# EasyEDA Pro project wukong01-Y003-HTOL.eprj, board PCB1 (continued)
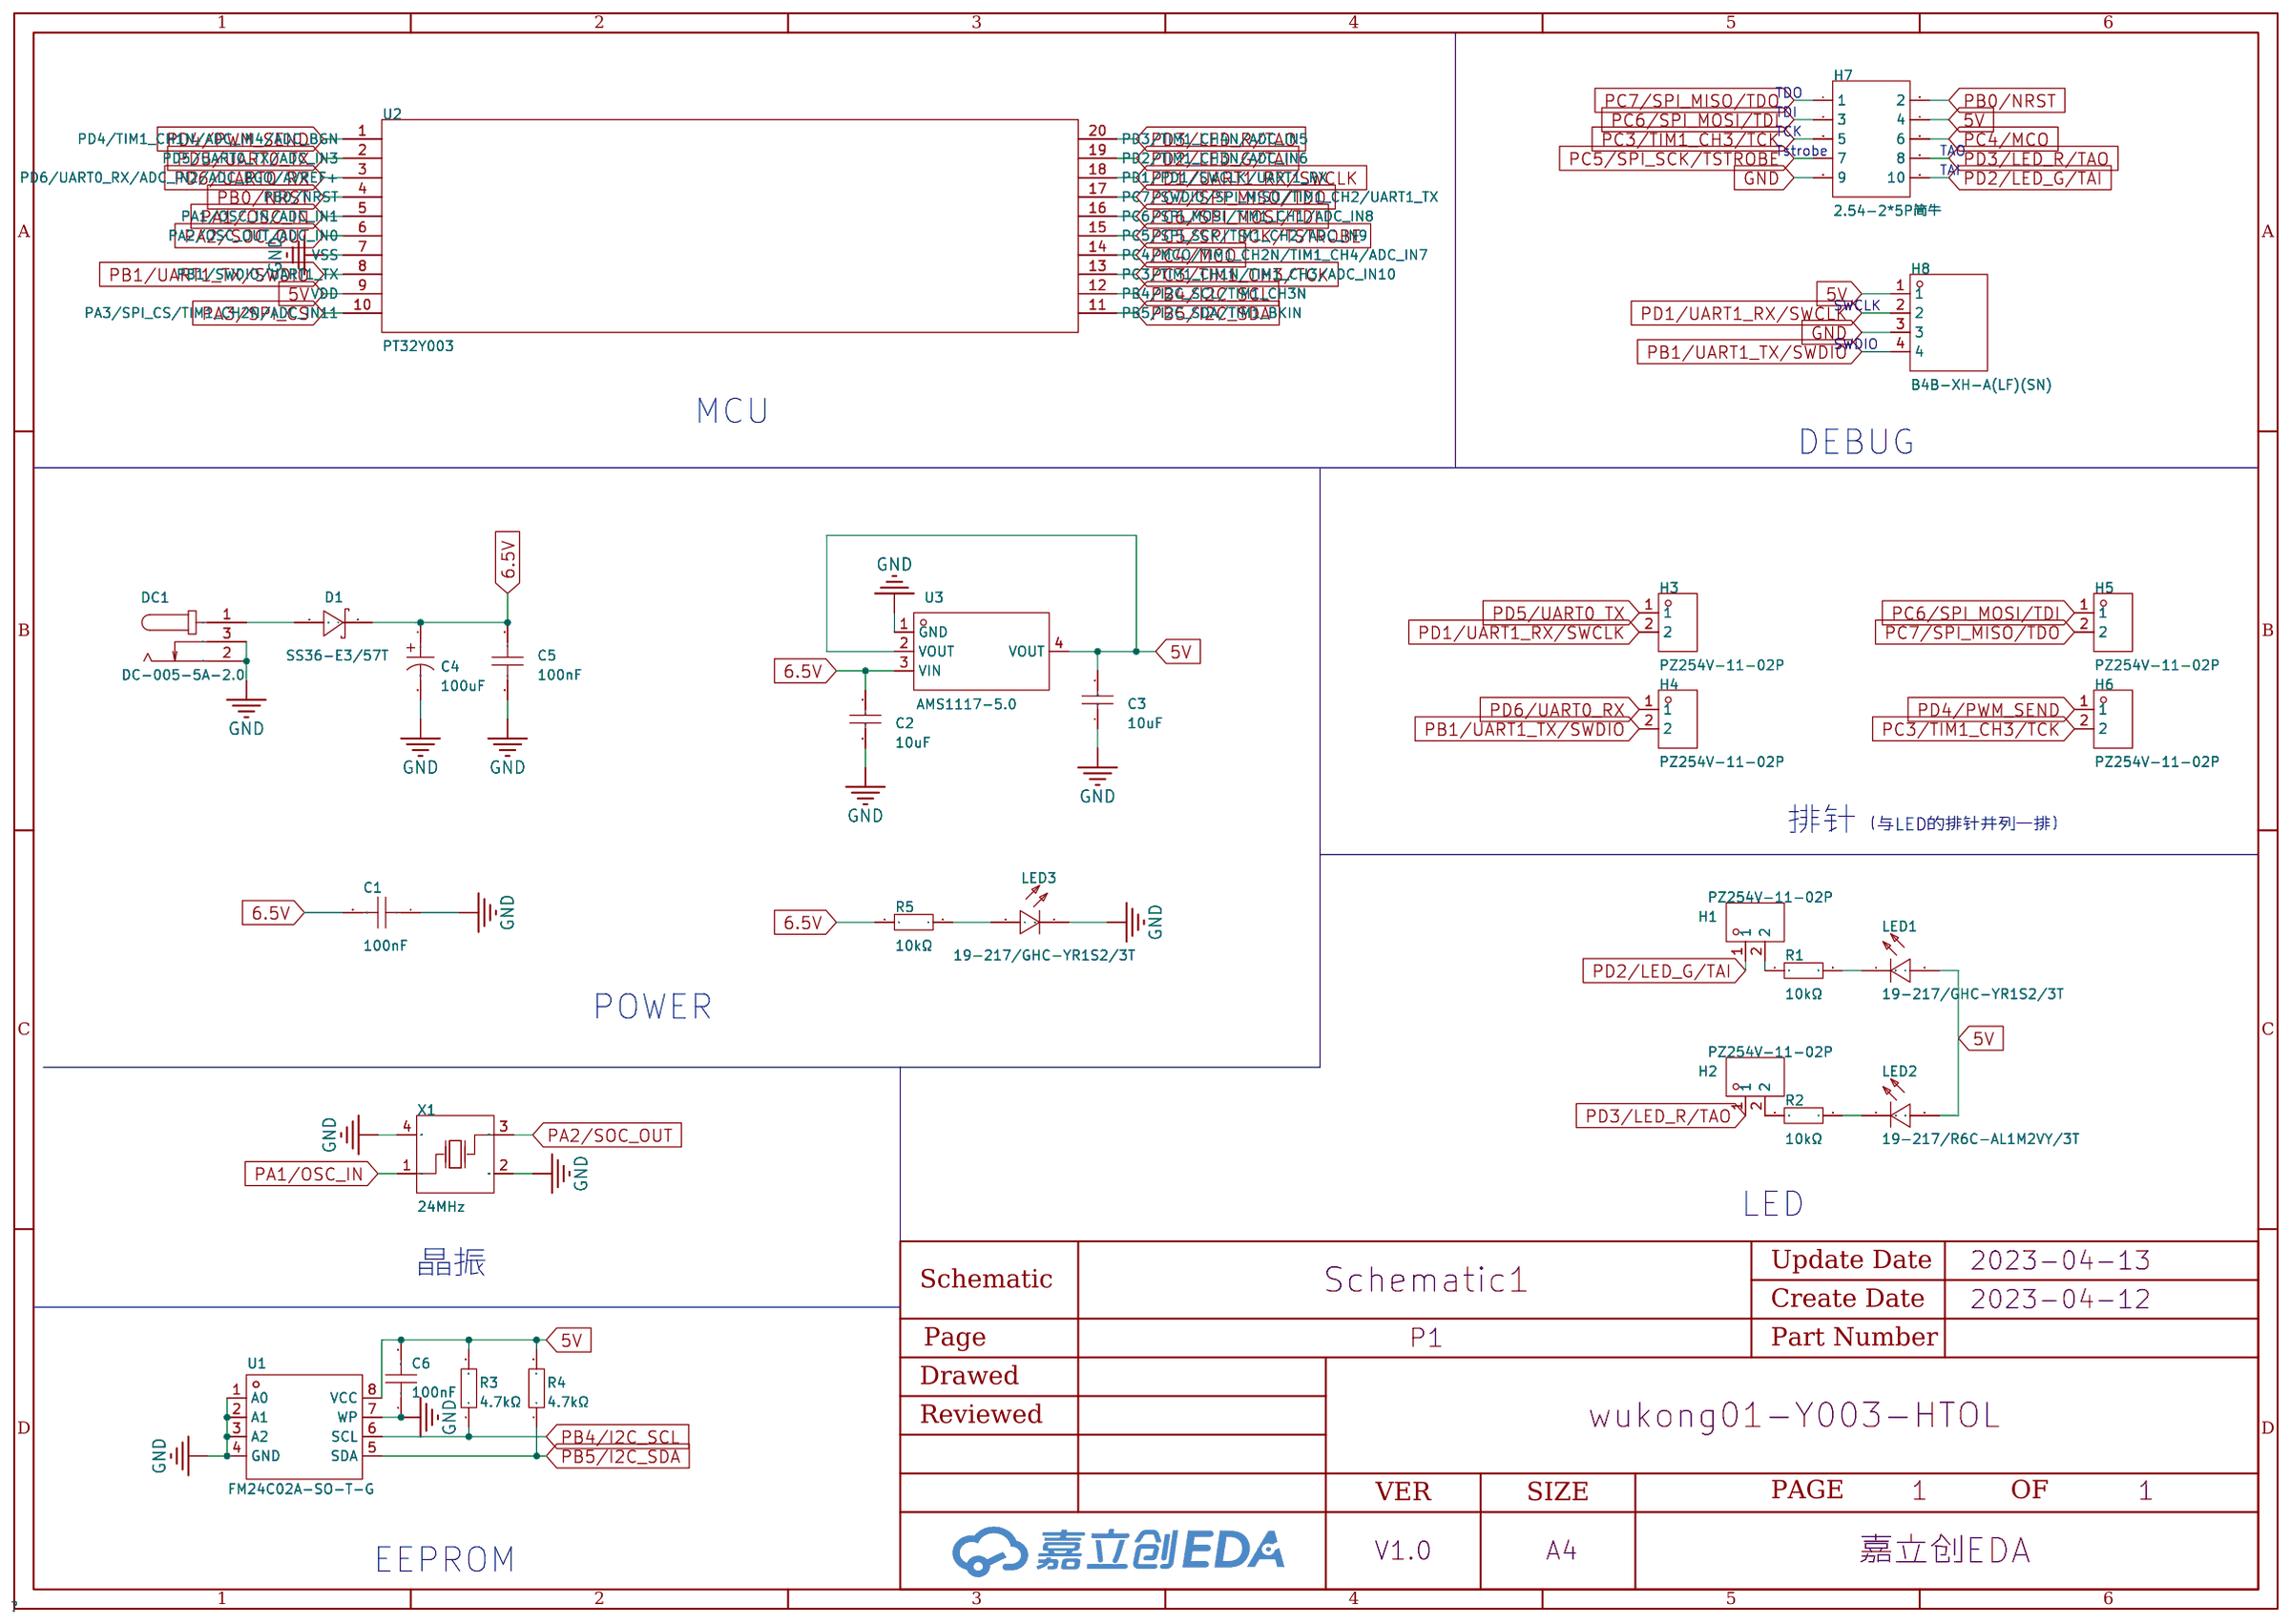
[diagram p0: schematic sheet]
## Placement (name value [footprint] x y rotation side) (continued)
H8#19  -  [CONN-TH_B4B-XH-A-LF-SN]  176.15 37.85 0 top
H8#20  -  [CONN-TH_B4B-XH-A-LF-SN]  127.13 37.85 0 top
H8#21  -  [CONN-TH_B4B-XH-A-LF-SN]  225.17 37.85 0 top
H8#22  -  [CONN-TH_B4B-XH-A-LF-SN]  225.17 80.77 0 top
H8#23  -  [CONN-TH_B4B-XH-A-LF-SN]  78.11 252.48 0 top
H8#24  -  [CONN-TH_B4B-XH-A-LF-SN]  176.15 252.48 0 top
H8#25  -  [CONN-TH_B4B-XH-A-LF-SN]  127.13 252.48 0 top
H8#26  -  [CONN-TH_B4B-XH-A-LF-SN]  274.19 252.48 0 top
H8#27  -  [CONN-TH_B4B-XH-A-LF-SN]  225.17 252.48 0 top
H8#28  -  [CONN-TH_B4B-XH-A-LF-SN]  29.08 252.48 0 top
H8#29  -  [CONN-TH_B4B-XH-A-LF-SN]  78.11 209.55 0 top
H8#30  -  [CONN-TH_B4B-XH-A-LF-SN]  176.15 209.55 0 top
H8#31  -  [CONN-TH_B4B-XH-A-LF-SN]  127.13 209.55 0 top
H8#32  -  [CONN-TH_B4B-XH-A-LF-SN]  274.19 209.55 0 top
H8#33  -  [CONN-TH_B4B-XH-A-LF-SN]  225.17 209.55 0 top
H8#34  -  [CONN-TH_B4B-XH-A-LF-SN]  29.08 209.55 0 top
H8#35  -  [CONN-TH_B4B-XH-A-LF-SN]  78.11 166.62 0 top
H8#36  -  [CONN-TH_B4B-XH-A-LF-SN]  176.15 166.62 0 top
H8#37  -  [CONN-TH_B4B-XH-A-LF-SN]  127.13 166.62 0 top
H8#38  -  [CONN-TH_B4B-XH-A-LF-SN]  274.19 166.62 0 top
H8#39  -  [CONN-TH_B4B-XH-A-LF-SN]  225.17 166.62 0 top
H8#40  -  [CONN-TH_B4B-XH-A-LF-SN]  29.08 166.62 0 top
LED1  19-217/GHC-YR1S2/3T  [LED0603-RD]  127.82 93.15 180 top
LED1#2  -  [LED0603-RD]  225.87 93.15 180 top
LED1#3  -  [LED0603-RD]  29.78 93.15 180 top
LED1#4  -  [LED0603-RD]  274.89 93.15 180 top
LED1#5  -  [LED0603-RD]  176.84 93.15 180 top
LED1#6  -  [LED0603-RD]  78.8 93.15 180 top
LED1#7  -  [LED0603-RD]  78.8 264.86 180 top
LED1#8  -  [LED0603-RD]  127.82 264.86 180 top
LED1#9  -  [LED0603-RD]  176.84 264.86 180 top
LED1#10  -  [LED0603-RD]  225.87 50.23 180 top
LED1#11  -  [LED0603-RD]  225.87 264.86 180 top
LED1#12  -  [LED0603-RD]  29.78 7.3 180 top
LED1#13  -  [LED0603-RD]  274.89 264.86 180 top
LED1#14  -  [LED0603-RD]  176.84 50.23 180 top
LED1#15  -  [LED0603-RD]  225.87 7.3 180 top
LED1#16  -  [LED0603-RD]  176.84 7.3 180 top
LED1#17  -  [LED0603-RD]  274.89 50.23 180 top
LED1#18  -  [LED0603-RD]  29.78 50.23 180 top
LED1#19  -  [LED0603-RD]  127.82 50.23 180 top
LED1#20  -  [LED0603-RD]  127.82 7.3 180 top
LED1#21  -  [LED0603-RD]  78.8 7.3 180 top
LED1#22  -  [LED0603-RD]  78.8 50.23 180 top
LED1#23  -  [LED0603-RD]  127.82 221.93 180 top
LED1#24  -  [LED0603-RD]  225.87 221.93 180 top
LED1#25  -  [LED0603-RD]  29.78 221.93 180 top
LED1#26  -  [LED0603-RD]  274.89 221.93 180 top
LED1#27  -  [LED0603-RD]  176.84 221.93 180 top
LED1#28  -  [LED0603-RD]  78.8 221.93 180 top
LED1#29  -  [LED0603-RD]  127.82 179 180 top
LED1#30  -  [LED0603-RD]  225.87 179 180 top
LED1#31  -  [LED0603-RD]  29.78 179 180 top
LED1#32  -  [LED0603-RD]  274.89 179 180 top
LED1#33  -  [LED0603-RD]  176.84 179 180 top
LED1#34  -  [LED0603-RD]  78.8 179 180 top
LED1#35  -  [LED0603-RD]  127.82 136.08 180 top
LED1#36  -  [LED0603-RD]  225.87 136.08 180 top
LED1#37  -  [LED0603-RD]  29.78 136.08 180 top
LED1#38  -  [LED0603-RD]  274.89 136.08 180 top
LED1#39  -  [LED0603-RD]  176.84 136.08 180 top
LED1#40  -  [LED0603-RD]  78.8 136.08 180 top
LED2  19-217/R6C-AL1M2VY/3T  [LED0603-R-RD]  29.84 137.8 180 top
LED2#2  -  [LED0603-R-RD]  127.89 137.8 180 top
LED2#3  -  [LED0603-R-RD]  176.91 137.8 180 top
LED2#4  -  [LED0603-R-RD]  274.96 137.8 180 top
LED2#5  -  [LED0603-R-RD]  225.93 94.87 180 top
LED2#6  -  [LED0603-R-RD]  78.87 94.87 180 top
LED2#7  -  [LED0603-R-RD]  29.84 94.87 180 top
LED2#8  -  [LED0603-R-RD]  127.89 94.87 180 top
LED2#9  -  [LED0603-R-RD]  176.91 94.87 180 top
LED2#10  -  [LED0603-R-RD]  274.96 94.87 180 top
LED2#11  -  [LED0603-R-RD]  78.87 266.57 180 top
LED2#12  -  [LED0603-R-RD]  176.91 266.57 180 top
LED2#13  -  [LED0603-R-RD]  127.89 266.57 180 top
LED2#14  -  [LED0603-R-RD]  274.96 266.57 180 top
LED2#15  -  [LED0603-R-RD]  225.93 266.57 180 top
LED2#16  -  [LED0603-R-RD]  29.84 9.02 180 top
LED2#17  -  [LED0603-R-RD]  78.87 51.94 180 top
LED2#18  -  [LED0603-R-RD]  176.91 9.02 180 top
LED2#19  -  [LED0603-R-RD]  127.89 9.02 180 top
LED2#20  -  [LED0603-R-RD]  225.93 51.94 180 top
LED2#21  -  [LED0603-R-RD]  78.87 9.02 180 top
LED2#22  -  [LED0603-R-RD]  127.89 51.94 180 top
LED2#23  -  [LED0603-R-RD]  176.91 51.94 180 top
LED2#24  -  [LED0603-R-RD]  225.93 9.02 180 top
LED2#25  -  [LED0603-R-RD]  274.96 51.94 180 top
LED2#26  -  [LED0603-R-RD]  29.84 51.94 180 top
LED2#27  -  [LED0603-R-RD]  225.93 223.65 180 top
LED2#28  -  [LED0603-R-RD]  78.87 223.65 180 top
LED2#29  -  [LED0603-R-RD]  29.84 223.65 180 top
LED2#30  -  [LED0603-R-RD]  127.89 223.65 180 top
LED2#31  -  [LED0603-R-RD]  176.91 223.65 180 top
LED2#32  -  [LED0603-R-RD]  274.96 223.65 180 top
LED2#33  -  [LED0603-R-RD]  225.93 180.72 180 top
LED2#34  -  [LED0603-R-RD]  78.87 180.72 180 top
LED2#35  -  [LED0603-R-RD]  29.84 180.72 180 top
LED2#36  -  [LED0603-R-RD]  127.89 180.72 180 top
LED2#37  -  [LED0603-R-RD]  176.91 180.72 180 top
LED2#38  -  [LED0603-R-RD]  274.96 180.72 180 top
LED2#39  -  [LED0603-R-RD]  225.93 137.8 180 top
LED2#40  -  [LED0603-R-RD]  78.87 137.8 180 top
LED3  19-217/GHC-YR1S2/3T  [LED0603-RD]  28.19 284.23 90 top
R1  10kΩ  [R0603]  230.5 93.09 180 top
R1#2  -  [R0603]  181.48 93.09 180 top
R1#3  -  [R0603]  279.53 93.09 180 top
R1#4  -  [R0603]  83.44 93.09 180 top
R1#5  -  [R0603]  34.42 93.09 180 top
R1#6  -  [R0603]  132.46 93.09 180 top
R1#7  -  [R0603]  83.44 264.8 180 top
R1#8  -  [R0603]  181.48 264.8 180 top
R1#9  -  [R0603]  132.46 264.8 180 top
R1#10  -  [R0603]  230.5 50.17 180 top
R1#11  -  [R0603]  279.53 264.8 180 top
R1#12  -  [R0603]  181.48 50.17 180 top
R1#13  -  [R0603]  230.5 264.8 180 top
R1#14  -  [R0603]  230.5 178.94 180 top
R1#15  -  [R0603]  181.48 7.24 180 top
R1#16  -  [R0603]  279.53 50.17 180 top
R1#17  -  [R0603]  83.44 50.17 180 top
R1#18  -  [R0603]  132.46 50.17 180 top
R1#19  -  [R0603]  230.5 7.24 180 top
R1#20  -  [R0603]  132.46 7.24 180 top
R1#21  -  [R0603]  34.42 50.17 180 top
R1#22  -  [R0603]  34.42 7.24 180 top
R1#23  -  [R0603]  83.44 7.24 180 top
R1#24  -  [R0603]  230.5 221.87 180 top
R1#25  -  [R0603]  181.48 221.87 180 top
R1#26  -  [R0603]  279.53 221.87 180 top
R1#27  -  [R0603]  83.44 221.87 180 top
R1#28  -  [R0603]  34.42 221.87 180 top
R1#29  -  [R0603]  132.46 221.87 180 top
R1#30  -  [R0603]  181.48 178.94 180 top
R1#31  -  [R0603]  279.53 178.94 180 top
R1#32  -  [R0603]  83.44 178.94 180 top
R1#33  -  [R0603]  34.42 178.94 180 top
R1#34  -  [R0603]  132.46 178.94 180 top
R1#35  -  [R0603]  230.5 136.02 180 top
R1#36  -  [R0603]  181.48 136.02 180 top
R1#37  -  [R0603]  279.53 136.02 180 top
R1#38  -  [R0603]  83.44 136.02 180 top
R1#39  -  [R0603]  34.42 136.02 180 top
R1#40  -  [R0603]  132.46 136.02 180 top
R2  10kΩ  [R0603]  230.49 94.74 180 top
R2#2  -  [R0603]  181.46 94.74 180 top
R2#3  -  [R0603]  279.51 94.74 180 top
R2#4  -  [R0603]  34.4 94.74 180 top
R2#5  -  [R0603]  132.44 94.74 180 top
R2#6  -  [R0603]  83.42 94.74 180 top
R2#7  -  [R0603]  83.42 266.44 180 top
R2#8  -  [R0603]  132.44 266.44 180 top
R2#9  -  [R0603]  181.46 266.44 180 top
R2#10  -  [R0603]  230.49 51.81 180 top
R2#11  -  [R0603]  230.49 266.44 180 top
R2#12  -  [R0603]  279.51 266.44 180 top
R2#13  -  [R0603]  181.46 51.81 180 top
R2#14  -  [R0603]  181.46 8.89 180 top
R2#15  -  [R0603]  279.51 51.81 180 top
R2#16  -  [R0603]  132.44 51.81 180 top
R2#17  -  [R0603]  132.44 8.89 180 top
R2#18  -  [R0603]  34.4 51.81 180 top
R2#19  -  [R0603]  34.4 8.89 180 top
R2#20  -  [R0603]  83.42 51.81 180 top
R2#21  -  [R0603]  230.49 8.89 180 top
R2#22  -  [R0603]  83.42 8.89 180 top
R2#23  -  [R0603]  230.49 223.52 180 top
R2#24  -  [R0603]  181.46 223.52 180 top
R2#25  -  [R0603]  279.51 223.52 180 top
R2#26  -  [R0603]  34.4 223.52 180 top
R2#27  -  [R0603]  132.44 223.52 180 top
R2#28  -  [R0603]  83.42 223.52 180 top
R2#29  -  [R0603]  230.49 180.59 180 top
R2#30  -  [R0603]  181.46 180.59 180 top
R2#31  -  [R0603]  279.51 180.59 180 top
R2#32  -  [R0603]  34.4 180.59 180 top
R2#33  -  [R0603]  132.44 180.59 180 top
R2#34  -  [R0603]  83.42 180.59 180 top
R2#35  -  [R0603]  230.49 137.66 180 top
R2#36  -  [R0603]  181.46 137.66 180 top
R2#37  -  [R0603]  279.51 137.66 180 top
R2#38  -  [R0603]  34.4 137.66 180 top
R2#39  -  [R0603]  132.44 137.66 180 top
R2#40  -  [R0603]  83.42 137.66 180 top
R3  4.7kΩ  [R0603]  22.99 137.67 0 top
R3#2  -  [R0603]  170.05 137.67 0 top
R3#3  -  [R0603]  121.03 94.74 0 top
R3#4  -  [R0603]  219.07 94.74 0 top
R3#5  -  [R0603]  72.01 94.74 0 top
R3#6  -  [R0603]  268.1 94.74 0 top
R3#7  -  [R0603]  22.99 94.74 0 top
R3#8  -  [R0603]  170.05 94.74 0 top
R3#9  -  [R0603]  72.01 266.45 0 top
R3#10  -  [R0603]  170.05 266.45 0 top
R3#11  -  [R0603]  121.03 266.45 0 top
R3#12  -  [R0603]  268.1 266.45 0 top
R3#13  -  [R0603]  219.07 266.45 0 top
R3#14  -  [R0603]  72.01 51.82 0 top
R3#15  -  [R0603]  121.03 51.82 0 top
R3#16  -  [R0603]  170.05 8.89 0 top
R3#17  -  [R0603]  268.1 51.82 0 top
R3#18  -  [R0603]  170.05 51.82 0 top
R3#19  -  [R0603]  219.07 8.89 0 top
R3#20  -  [R0603]  219.07 51.82 0 top
R3#21  -  [R0603]  72.01 8.89 0 top
R3#22  -  [R0603]  22.99 8.89 0 top
R3#23  -  [R0603]  121.03 8.89 0 top
R3#24  -  [R0603]  22.99 51.82 0 top
R3#25  -  [R0603]  121.03 223.52 0 top
R3#26  -  [R0603]  219.07 223.52 0 top
R3#27  -  [R0603]  72.01 223.52 0 top
R3#28  -  [R0603]  268.1 223.52 0 top
R3#29  -  [R0603]  22.99 223.52 0 top
R3#30  -  [R0603]  170.05 223.52 0 top
R3#31  -  [R0603]  121.03 180.59 0 top
R3#32  -  [R0603]  219.07 180.59 0 top
R3#33  -  [R0603]  72.01 180.59 0 top
R3#34  -  [R0603]  268.1 180.59 0 top
R3#35  -  [R0603]  22.99 180.59 0 top
R3#36  -  [R0603]  170.05 180.59 0 top
R3#37  -  [R0603]  121.03 137.67 0 top
R3#38  -  [R0603]  219.07 137.67 0 top
R3#39  -  [R0603]  72.01 137.67 0 top
R3#40  -  [R0603]  268.1 137.67 0 top
R4  4.7kΩ  [R0603]  22.99 136.02 0 top
R4#2  -  [R0603]  121.03 93.09 0 top
R4#3  -  [R0603]  268.1 93.09 0 top
R4#4  -  [R0603]  219.07 93.09 0 top
R4#5  -  [R0603]  72.01 93.09 0 top
R4#6  -  [R0603]  170.05 93.09 0 top
R4#7  -  [R0603]  22.99 93.09 0 top
R4#8  -  [R0603]  72.01 264.8 0 top
R4#9  -  [R0603]  170.05 264.8 0 top
R4#10  -  [R0603]  121.03 264.8 0 top
R4#11  -  [R0603]  268.1 264.8 0 top
R4#12  -  [R0603]  170.05 50.17 0 top
R4#13  -  [R0603]  121.03 50.17 0 top
R4#14  -  [R0603]  268.1 50.17 0 top
R4#15  -  [R0603]  219.07 264.8 0 top
R4#16  -  [R0603]  22.99 50.17 0 top
R4#17  -  [R0603]  72.01 50.17 0 top
R4#18  -  [R0603]  219.07 7.24 0 top
R4#19  -  [R0603]  121.03 7.24 0 top
R4#20  -  [R0603]  170.05 7.24 0 top
R4#21  -  [R0603]  219.07 50.17 0 top
R4#22  -  [R0603]  22.99 7.24 0 top
R4#23  -  [R0603]  72.01 7.24 0 top
R4#24  -  [R0603]  121.03 221.87 0 top
R4#25  -  [R0603]  268.1 221.87 0 top
R4#26  -  [R0603]  219.07 221.87 0 top
R4#27  -  [R0603]  72.01 221.87 0 top
R4#28  -  [R0603]  170.05 221.87 0 top
R4#29  -  [R0603]  22.99 221.87 0 top
R4#30  -  [R0603]  121.03 178.94 0 top
R4#31  -  [R0603]  268.1 178.94 0 top
R4#32  -  [R0603]  219.07 178.94 0 top
R4#33  -  [R0603]  72.01 178.94 0 top
R4#34  -  [R0603]  170.05 178.94 0 top
R4#35  -  [R0603]  22.99 178.94 0 top
R4#36  -  [R0603]  121.03 136.02 0 top
R4#37  -  [R0603]  268.1 136.02 0 top
R4#38  -  [R0603]  219.07 136.02 0 top
R4#39  -  [R0603]  72.01 136.02 0 top
R4#40  -  [R0603]  170.05 136.02 0 top
R5  10kΩ  [R0603]  28.19 288.54 90 top
U1  FM24C02A-SO-T-G  [SOP-8_L5.0-W4.0-P1.27-LS6.2-BL]  62.23 98.68 270 top
U1#2  -  [SOP-8_L5.0-W4.0-P1.27-LS6.2-BL]  258.32 98.68 270 top
U1#3  -  [SOP-8_L5.0-W4.0-P1.27-LS6.2-BL]  111.25 98.68 270 top
U1#4  -  [SOP-8_L5.0-W4.0-P1.27-LS6.2-BL]  209.3 98.68 270 top
U1#5  -  [SOP-8_L5.0-W4.0-P1.27-LS6.2-BL]  13.21 98.68 270 top
U1#6  -  [SOP-8_L5.0-W4.0-P1.27-LS6.2-BL]  160.27 98.68 270 top
U1#7  -  [SOP-8_L5.0-W4.0-P1.27-LS6.2-BL]  62.23 270.38 270 top
U1#8  -  [SOP-8_L5.0-W4.0-P1.27-LS6.2-BL]  160.27 270.38 270 top
U1#9  -  [SOP-8_L5.0-W4.0-P1.27-LS6.2-BL]  111.25 270.38 270 top
U1#10  -  [SOP-8_L5.0-W4.0-P1.27-LS6.2-BL]  258.32 270.38 270 top
U1#11  -  [SOP-8_L5.0-W4.0-P1.27-LS6.2-BL]  62.23 55.75 270 top
U1#12  -  [SOP-8_L5.0-W4.0-P1.27-LS6.2-BL]  13.21 12.83 270 top
U1#13  -  [SOP-8_L5.0-W4.0-P1.27-LS6.2-BL]  209.3 270.38 270 top
U1#14  -  [SOP-8_L5.0-W4.0-P1.27-LS6.2-BL]  258.32 55.75 270 top
U1#15  -  [SOP-8_L5.0-W4.0-P1.27-LS6.2-BL]  209.3 55.75 270 top
U1#16  -  [SOP-8_L5.0-W4.0-P1.27-LS6.2-BL]  62.23 12.83 270 top
U1#17  -  [SOP-8_L5.0-W4.0-P1.27-LS6.2-BL]  160.27 55.75 270 top
U1#18  -  [SOP-8_L5.0-W4.0-P1.27-LS6.2-BL]  111.25 55.75 270 top
U1#19  -  [SOP-8_L5.0-W4.0-P1.27-LS6.2-BL]  209.3 12.83 270 top
U1#20  -  [SOP-8_L5.0-W4.0-P1.27-LS6.2-BL]  160.27 12.83 270 top
U1#21  -  [SOP-8_L5.0-W4.0-P1.27-LS6.2-BL]  111.25 12.83 270 top
U1#22  -  [SOP-8_L5.0-W4.0-P1.27-LS6.2-BL]  13.21 55.75 270 top
U1#23  -  [SOP-8_L5.0-W4.0-P1.27-LS6.2-BL]  62.23 227.46 270 top
U1#24  -  [SOP-8_L5.0-W4.0-P1.27-LS6.2-BL]  258.32 227.46 270 top
U1#25  -  [SOP-8_L5.0-W4.0-P1.27-LS6.2-BL]  111.25 227.46 270 top
U1#26  -  [SOP-8_L5.0-W4.0-P1.27-LS6.2-BL]  209.3 227.46 270 top
U1#27  -  [SOP-8_L5.0-W4.0-P1.27-LS6.2-BL]  13.21 227.46 270 top
U1#28  -  [SOP-8_L5.0-W4.0-P1.27-LS6.2-BL]  160.27 227.46 270 top
U1#29  -  [SOP-8_L5.0-W4.0-P1.27-LS6.2-BL]  62.23 184.53 270 top
U1#30  -  [SOP-8_L5.0-W4.0-P1.27-LS6.2-BL]  258.32 184.53 270 top
U1#31  -  [SOP-8_L5.0-W4.0-P1.27-LS6.2-BL]  111.25 184.53 270 top
U1#32  -  [SOP-8_L5.0-W4.0-P1.27-LS6.2-BL]  209.3 184.53 270 top
U1#33  -  [SOP-8_L5.0-W4.0-P1.27-LS6.2-BL]  13.21 184.53 270 top
U1#34  -  [SOP-8_L5.0-W4.0-P1.27-LS6.2-BL]  160.27 184.53 270 top
U1#35  -  [SOP-8_L5.0-W4.0-P1.27-LS6.2-BL]  62.23 141.61 270 top
U1#36  -  [SOP-8_L5.0-W4.0-P1.27-LS6.2-BL]  258.32 141.61 270 top
U1#37  -  [SOP-8_L5.0-W4.0-P1.27-LS6.2-BL]  111.25 141.61 270 top
U1#38  -  [SOP-8_L5.0-W4.0-P1.27-LS6.2-BL]  209.3 141.61 270 top
U1#39  -  [SOP-8_L5.0-W4.0-P1.27-LS6.2-BL]  13.21 141.61 270 top
U1#40  -  [SOP-8_L5.0-W4.0-P1.27-LS6.2-BL]  160.27 141.61 270 top
U2  PT32Y003  [TSSOP-20_L6.5-W4.4-P0.65-LS6.4-BL]  29.84 145.8 270 top
U2#2  -  [TSSOP-20_L6.5-W4.4-P0.65-LS6.4-BL]  127.89 102.87 270 top
U2#3  -  [TSSOP-20_L6.5-W4.4-P0.65-LS6.4-BL]  274.96 102.87 270 top
U2#4  -  [TSSOP-20_L6.5-W4.4-P0.65-LS6.4-BL]  225.93 102.87 270 top
U2#5  -  [TSSOP-20_L6.5-W4.4-P0.65-LS6.4-BL]  78.87 102.87 270 top
U2#6  -  [TSSOP-20_L6.5-W4.4-P0.65-LS6.4-BL]  176.91 102.87 270 top
U2#7  -  [TSSOP-20_L6.5-W4.4-P0.65-LS6.4-BL]  176.91 59.94 270 top
U2#8  -  [TSSOP-20_L6.5-W4.4-P0.65-LS6.4-BL]  29.84 102.87 270 top
U2#9  -  [TSSOP-20_L6.5-W4.4-P0.65-LS6.4-BL]  78.87 274.57 270 top
U2#10  -  [TSSOP-20_L6.5-W4.4-P0.65-LS6.4-BL]  176.91 274.57 270 top
U2#11  -  [TSSOP-20_L6.5-W4.4-P0.65-LS6.4-BL]  127.89 274.57 270 top
U2#12  -  [TSSOP-20_L6.5-W4.4-P0.65-LS6.4-BL]  274.96 59.94 270 top
U2#13  -  [TSSOP-20_L6.5-W4.4-P0.65-LS6.4-BL]  274.96 274.57 270 top
U2#14  -  [TSSOP-20_L6.5-W4.4-P0.65-LS6.4-BL]  78.87 59.94 270 top
U2#15  -  [TSSOP-20_L6.5-W4.4-P0.65-LS6.4-BL]  127.89 59.94 270 top
U2#16  -  [TSSOP-20_L6.5-W4.4-P0.65-LS6.4-BL]  225.93 274.57 270 top
U2#17  -  [TSSOP-20_L6.5-W4.4-P0.65-LS6.4-BL]  176.91 17.02 270 top
U2#18  -  [TSSOP-20_L6.5-W4.4-P0.65-LS6.4-BL]  127.89 17.02 270 top
U2#19  -  [TSSOP-20_L6.5-W4.4-P0.65-LS6.4-BL]  225.93 59.94 270 top
U2#20  -  [TSSOP-20_L6.5-W4.4-P0.65-LS6.4-BL]  29.84 59.94 270 top
U2#21  -  [TSSOP-20_L6.5-W4.4-P0.65-LS6.4-BL]  225.93 17.02 270 top
U2#22  -  [TSSOP-20_L6.5-W4.4-P0.65-LS6.4-BL]  29.84 17.02 270 top
U2#23  -  [TSSOP-20_L6.5-W4.4-P0.65-LS6.4-BL]  78.87 17.02 270 top
U2#24  -  [TSSOP-20_L6.5-W4.4-P0.65-LS6.4-BL]  127.89 231.65 270 top
U2#25  -  [TSSOP-20_L6.5-W4.4-P0.65-LS6.4-BL]  274.96 231.65 270 top
U2#26  -  [TSSOP-20_L6.5-W4.4-P0.65-LS6.4-BL]  225.93 231.65 270 top
U2#27  -  [TSSOP-20_L6.5-W4.4-P0.65-LS6.4-BL]  78.87 231.65 270 top
U2#28  -  [TSSOP-20_L6.5-W4.4-P0.65-LS6.4-BL]  176.91 231.65 270 top
U2#29  -  [TSSOP-20_L6.5-W4.4-P0.65-LS6.4-BL]  29.84 231.65 270 top
U2#30  -  [TSSOP-20_L6.5-W4.4-P0.65-LS6.4-BL]  127.89 188.72 270 top
U2#31  -  [TSSOP-20_L6.5-W4.4-P0.65-LS6.4-BL]  274.96 188.72 270 top
U2#32  -  [TSSOP-20_L6.5-W4.4-P0.65-LS6.4-BL]  225.93 188.72 270 top
U2#33  -  [TSSOP-20_L6.5-W4.4-P0.65-LS6.4-BL]  78.87 188.72 270 top
U2#34  -  [TSSOP-20_L6.5-W4.4-P0.65-LS6.4-BL]  176.91 188.72 270 top
U2#35  -  [TSSOP-20_L6.5-W4.4-P0.65-LS6.4-BL]  29.84 188.72 270 top
U2#36  -  [TSSOP-20_L6.5-W4.4-P0.65-LS6.4-BL]  127.89 145.8 270 top
U2#37  -  [TSSOP-20_L6.5-W4.4-P0.65-LS6.4-BL]  274.96 145.8 270 top
U2#38  -  [TSSOP-20_L6.5-W4.4-P0.65-LS6.4-BL]  225.93 145.8 270 top
U2#39  -  [TSSOP-20_L6.5-W4.4-P0.65-LS6.4-BL]  78.87 145.8 270 top
U2#40  -  [TSSOP-20_L6.5-W4.4-P0.65-LS6.4-BL]  176.91 145.8 270 top
U3  AMS1117-5.0  [SOT-223_L6.5-W3.5-P2.30-LS7.0-BR]  10.92 272.03 90 top
U3#2  -  [SOT-223_L6.5-W3.5-P2.30-LS7.0-BR]  23.88 271.99 90 top
U3#3  -  [SOT-223_L6.5-W3.5-P2.30-LS7.0-BR]  37.06 271.99 90 top
U3#4  -  [SOT-223_L6.5-W3.5-P2.30-LS7.0-BR]  42.67 291.59 180 top
X1  24MHz  [CRYSTAL-SMD_4P-L3.2-W2.5-BL]  209.42 110.87 180 top
X1#2  -  [CRYSTAL-SMD_4P-L3.2-W2.5-BL]  62.36 110.87 180 top
X1#3  -  [CRYSTAL-SMD_4P-L3.2-W2.5-BL]  111.38 110.87 180 top
X1#4  -  [CRYSTAL-SMD_4P-L3.2-W2.5-BL]  258.44 110.87 180 top
X1#5  -  [CRYSTAL-SMD_4P-L3.2-W2.5-BL]  13.34 110.87 180 top
X1#6  -  [CRYSTAL-SMD_4P-L3.2-W2.5-BL]  160.4 110.87 180 top
X1#7  -  [CRYSTAL-SMD_4P-L3.2-W2.5-BL]  62.36 282.57 180 top
X1#8  -  [CRYSTAL-SMD_4P-L3.2-W2.5-BL]  160.4 282.57 180 top
X1#9  -  [CRYSTAL-SMD_4P-L3.2-W2.5-BL]  111.38 282.57 180 top
X1#10  -  [CRYSTAL-SMD_4P-L3.2-W2.5-BL]  62.36 67.95 180 top
X1#11  -  [CRYSTAL-SMD_4P-L3.2-W2.5-BL]  258.44 282.57 180 top
X1#12  -  [CRYSTAL-SMD_4P-L3.2-W2.5-BL]  209.42 282.57 180 top
X1#13  -  [CRYSTAL-SMD_4P-L3.2-W2.5-BL]  111.38 25.02 180 top
X1#14  -  [CRYSTAL-SMD_4P-L3.2-W2.5-BL]  62.36 25.02 180 top
X1#15  -  [CRYSTAL-SMD_4P-L3.2-W2.5-BL]  160.4 67.95 180 top
X1#16  -  [CRYSTAL-SMD_4P-L3.2-W2.5-BL]  258.44 67.95 180 top
X1#17  -  [CRYSTAL-SMD_4P-L3.2-W2.5-BL]  13.34 67.95 180 top
X1#18  -  [CRYSTAL-SMD_4P-L3.2-W2.5-BL]  111.38 67.95 180 top
X1#19  -  [CRYSTAL-SMD_4P-L3.2-W2.5-BL]  209.42 67.95 180 top
X1#20  -  [CRYSTAL-SMD_4P-L3.2-W2.5-BL]  209.42 25.02 180 top
X1#21  -  [CRYSTAL-SMD_4P-L3.2-W2.5-BL]  160.4 25.02 180 top
X1#22  -  [CRYSTAL-SMD_4P-L3.2-W2.5-BL]  13.34 25.02 180 top
X1#23  -  [CRYSTAL-SMD_4P-L3.2-W2.5-BL]  209.42 239.65 180 top
X1#24  -  [CRYSTAL-SMD_4P-L3.2-W2.5-BL]  62.36 239.65 180 top
X1#25  -  [CRYSTAL-SMD_4P-L3.2-W2.5-BL]  111.38 239.65 180 top
X1#26  -  [CRYSTAL-SMD_4P-L3.2-W2.5-BL]  258.44 239.65 180 top
X1#27  -  [CRYSTAL-SMD_4P-L3.2-W2.5-BL]  13.34 239.65 180 top
X1#28  -  [CRYSTAL-SMD_4P-L3.2-W2.5-BL]  160.4 239.65 180 top
X1#29  -  [CRYSTAL-SMD_4P-L3.2-W2.5-BL]  209.42 196.72 180 top
X1#30  -  [CRYSTAL-SMD_4P-L3.2-W2.5-BL]  62.36 196.72 180 top
X1#31  -  [CRYSTAL-SMD_4P-L3.2-W2.5-BL]  111.38 196.72 180 top
X1#32  -  [CRYSTAL-SMD_4P-L3.2-W2.5-BL]  258.44 196.72 180 top
X1#33  -  [CRYSTAL-SMD_4P-L3.2-W2.5-BL]  13.34 196.72 180 top
X1#34  -  [CRYSTAL-SMD_4P-L3.2-W2.5-BL]  160.4 196.72 180 top
X1#35  -  [CRYSTAL-SMD_4P-L3.2-W2.5-BL]  209.42 153.8 180 top
X1#36  -  [CRYSTAL-SMD_4P-L3.2-W2.5-BL]  62.36 153.8 180 top
X1#37  -  [CRYSTAL-SMD_4P-L3.2-W2.5-BL]  111.38 153.8 180 top
X1#38  -  [CRYSTAL-SMD_4P-L3.2-W2.5-BL]  258.44 153.8 180 top
X1#39  -  [CRYSTAL-SMD_4P-L3.2-W2.5-BL]  13.34 153.8 180 top
X1#40  -  [CRYSTAL-SMD_4P-L3.2-W2.5-BL]  160.4 153.8 180 top

## Footprints (pads in the part's own frame, mm; a bottom-side part is the same pattern mirrored in y, then rotated)
C0603
  rect 0.8x0.9 smd: 1(-0.7,0) 2(0.7,0)
C1206
  rect 1.485x1.728 smd: 1(-1.593,0) 2(1.593,0)
CAP-SMD_BD6.3-L6.6-W6.6-LS7.6-FD-1
  rect 3.5x1.2 smd: 1(-2.67,0) 2(2.67,0)
CONN-TH_B4B-XH-A-LF-SN
  round 1.7 hole 1: 1(-3.81,0) 2(-1.27,0) 3(1.27,0) 4(3.81,0)
CRYSTAL-SMD_4P-L3.2-W2.5-BL
  rect 1.4x1.2 smd: 1(-1.1,-0.85) 2(1.1,-0.85) 3(1.1,0.85) 4(-1.1,0.85)
DC-IN-TH_DC-005-5A-2.0
  oval 1.8x4.2 hole 1x3.5: 1(3,2.352)
  oval 1.8x4 hole 1x3.3: 2(-3,2.352)
  oval 4x1.8 hole 3.3x1: 3(-0.001,-2.352)
HDR-TH_2P-P2.54-V-M
  rect 2x2 hole 1.2: 1(-1.27,0)
  round 2 hole 1.2: 2(1.27,0)
IDC-TH_10P-P2.54_C5665
  round 1.524 hole 1: 1(-5.08,-1.27) 2(-5.08,1.27) 3(-2.54,-1.27) 4(-2.54,1.27) 5(0,-1.27) 6(0,1.27) 7(2.54,-1.27) 8(2.54,1.27) 9(5.08,-1.27) 10(5.08,1.27)
LED0603-R-RD
  rect 0.8x0.8 smd: 1(0.851,0) 2(-0.851,0)
LED0603-RD
  rect 0.8x0.8 smd: 1(-0.799,-0.004) 2(0.799,0.004)
R0603
  rect 0.806x0.864 smd: 1(-0.753,0) 2(0.753,0)
SMC_L7.1-W6.2-LS8.1-R-RD
  rect 3.03x3.82 smd: 1(3.435,0) 2(-3.435,0)
SOP-8_L5.0-W4.0-P1.27-LS6.2-BL
  oval 0.7x1.7 smd: 1(-1.905,-2.9) 2(-0.635,-2.9) 3(0.635,-2.9) 4(1.905,-2.9) 5(1.905,2.9) 6(0.635,2.9) 7(-0.635,2.9) 8(-1.905,2.9)
SOT-223_L6.5-W3.5-P2.30-LS7.0-BR
  rect 2.465x1.05 smd: 1(2.857,-2.3) 2(2.857,0) 3(2.857,2.3)
  rect 2.465x3.54 smd: 4(-2.857,0)
TSSOP-20_L6.5-W4.4-P0.65-LS6.4-BL
  oval 0.364x1.742 smd: 1(-2.925,-2.871) 2(-2.275,-2.871) 3(-1.625,-2.871) 4(-0.975,-2.871) 5(-0.325,-2.871) 6(0.325,-2.871) 7(0.975,-2.871) 8(1.625,-2.871) 9(2.275,-2.871) 10(2.925,-2.871) 11(2.925,2.871) 12(2.275,2.871) 13(1.625,2.871) 14(0.975,2.871) 15(0.325,2.871) 16(-0.325,2.871) 17(-0.975,2.871) 18(-1.625,2.871) 19(-2.275,2.871) 20(-2.925,2.871)

## Nets
5V: C3.2 C3#2.2 C3#3.2 C3#4.2 C6.2 C6#2.2 C6#3.2 C6#4.2 C6#5.2 C6#6.2 C6#7.2 C6#8.2 C6#9.2 C6#10.2 C6#11.2 C6#12.2 C6#13.2 C6#14.2 C6#15.2 C6#16.2 C6#17.2 C6#18.2 C6#19.2 C6#20.2 C6#21.2 C6#22.2 C6#23.2 C6#24.2 C6#25.2 C6#26.2 C6#27.2 C6#28.2 C6#29.2 C6#30.2 C6#31.2 C6#32.2 C6#33.2 C6#34.2 C6#35.2 C6#36.2 C6#37.2 C6#38.2 C6#39.2 C6#40.2 H7.4 H7#2.4 H7#3.4 H7#4.4 H7#5.4 H7#6.4 H7#7.4 H7#8.4 H7#9.4 H7#10.4 H7#11.4 H7#12.4 H7#13.4 H7#14.4 H7#15.4 H7#16.4 H7#17.4 H7#18.4 H7#19.4 H7#20.4 H7#21.4 H7#22.4 H7#23.4 H7#24.4 H7#25.4 H7#26.4 H7#27.4 H7#28.4 H7#29.4 H7#30.4 H7#31.4 H7#32.4 H7#33.4 H7#34.4 H7#35.4 H7#36.4 H7#37.4 H7#38.4 H7#39.4 H7#40.4 H8.1 H8#2.1 H8#3.1 H8#4.1 H8#5.1 H8#6.1 H8#7.1 H8#8.1 H8#9.1 H8#10.1 H8#11.1 H8#12.1 H8#13.1 H8#14.1 H8#15.1 H8#16.1 H8#17.1 H8#18.1 H8#19.1 H8#20.1 H8#21.1 H8#22.1 H8#23.1 H8#24.1 H8#25.1 H8#26.1 H8#27.1 H8#28.1 H8#29.1 H8#30.1 H8#31.1 H8#32.1 H8#33.1 H8#34.1 H8#35.1 H8#36.1 H8#37.1 H8#38.1 H8#39.1 H8#40.1 LED1.2 LED1#2.2 LED1#3.2 LED1#4.2 LED1#5.2 LED1#6.2 LED1#7.2 LED1#8.2 LED1#9.2 LED1#10.2 LED1#11.2 LED1#12.2 LED1#13.2 LED1#14.2 LED1#15.2 LED1#16.2 LED1#17.2 LED1#18.2 LED1#19.2 LED1#20.2 LED1#21.2 LED1#22.2 LED1#23.2 LED1#24.2 LED1#25.2 LED1#26.2 LED1#27.2 LED1#28.2 LED1#29.2 LED1#30.2 LED1#31.2 LED1#32.2 LED1#33.2 LED1#34.2 LED1#35.2 LED1#36.2 LED1#37.2 LED1#38.2 LED1#39.2 LED1#40.2 LED2.1 LED2#2.1 LED2#3.1 LED2#4.1 LED2#5.1 LED2#6.1 LED2#7.1 LED2#8.1 LED2#9.1 LED2#10.1 LED2#11.1 LED2#12.1 LED2#13.1 LED2#14.1 LED2#15.1 LED2#16.1 LED2#17.1 LED2#18.1 LED2#19.1 LED2#20.1 LED2#21.1 LED2#22.1 LED2#23.1 LED2#24.1 LED2#25.1 LED2#26.1 LED2#27.1 LED2#28.1 LED2#29.1 LED2#30.1 LED2#31.1 LED2#32.1 LED2#33.1 LED2#34.1 LED2#35.1 LED2#36.1 LED2#37.1 LED2#38.1 LED2#39.1 LED2#40.1 R3.2 R3#2.2 R3#3.2 R3#4.2 R3#5.2 R3#6.2 R3#7.2 R3#8.2 R3#9.2 R3#10.2 R3#11.2 R3#12.2 R3#13.2 R3#14.2 R3#15.2 R3#16.2 R3#17.2 R3#18.2 R3#19.2 R3#20.2 R3#21.2 R3#22.2 R3#23.2 R3#24.2 R3#25.2 R3#26.2 R3#27.2 R3#28.2 R3#29.2 R3#30.2 R3#31.2 R3#32.2 R3#33.2 R3#34.2 R3#35.2 R3#36.2 R3#37.2 R3#38.2 R3#39.2 R3#40.2 R4.2 R4#2.2 R4#3.2 R4#4.2 R4#5.2 R4#6.2 R4#7.2 R4#8.2 R4#9.2 R4#10.2 R4#11.2 R4#12.2 R4#13.2 R4#14.2 R4#15.2 R4#16.2 R4#17.2 R4#18.2 R4#19.2 R4#20.2 R4#21.2 R4#22.2 R4#23.2 R4#24.2 R4#25.2 R4#26.2 R4#27.2 R4#28.2 R4#29.2 R4#30.2 R4#31.2 R4#32.2 R4#33.2 R4#34.2 R4#35.2 R4#36.2 R4#37.2 R4#38.2 R4#39.2 R4#40.2 U1.8 U1#2.8 U1#3.8 U1#4.8 U1#5.8 U1#6.8 U1#7.8 U1#8.8 U1#9.8 U1#10.8 U1#11.8 U1#12.8 U1#13.8 U1#14.8 U1#15.8 U1#16.8 U1#17.8 U1#18.8 U1#19.8 U1#20.8 U1#21.8 U1#22.8 U1#23.8 U1#24.8 U1#25.8 U1#26.8 U1#27.8 U1#28.8 U1#29.8 U1#30.8 U1#31.8 U1#32.8 U1#33.8 U1#34.8 U1#35.8 U1#36.8 U1#37.8 U1#38.8 U1#39.8 U1#40.8 U2.9 U2#2.9 U2#3.9 U2#4.9 U2#5.9 U2#6.9 U2#7.9 U2#8.9 U2#9.9 U2#10.9 U2#11.9 U2#12.9 U2#13.9 U2#14.9 U2#15.9 U2#16.9 U2#17.9 U2#18.9 U2#19.9 U2#20.9 U2#21.9 U2#22.9 U2#23.9 U2#24.9 U2#25.9 U2#26.9 U2#27.9 U2#28.9 U2#29.9 U2#30.9 U2#31.9 U2#32.9 U2#33.9 U2#34.9 U2#35.9 U2#36.9 U2#37.9 U2#38.9 U2#39.9 U2#40.9 U3.2 U3.4 U3#2.2 U3#2.4 U3#3.2 U3#3.4 U3#4.2 U3#4.4
6.5V: C1.2 C2.1 C4.1 C5.2 D1.2 R5.2 U3.3 U3#2.3 U3#3.3 U3#4.3
GND: C1.1 C2.2 C3.1 C3#2.1 C3#3.1 C3#4.1 C4.2 C5.1 C6.1 C6#2.1 C6#3.1 C6#4.1 C6#5.1 C6#6.1 C6#7.1 C6#8.1 C6#9.1 C6#10.1 C6#11.1 C6#12.1 C6#13.1 C6#14.1 C6#15.1 C6#16.1 C6#17.1 C6#18.1 C6#19.1 C6#20.1 C6#21.1 C6#22.1 C6#23.1 C6#24.1 C6#25.1 C6#26.1 C6#27.1 C6#28.1 C6#29.1 C6#30.1 C6#31.1 C6#32.1 C6#33.1 C6#34.1 C6#35.1 C6#36.1 C6#37.1 C6#38.1 C6#39.1 C6#40.1 DC1.2 DC1.3 H7.9 H7#2.9 H7#3.9 H7#4.9 H7#5.9 H7#6.9 H7#7.9 H7#8.9 H7#9.9 H7#10.9 H7#11.9 H7#12.9 H7#13.9 H7#14.9 H7#15.9 H7#16.9 H7#17.9 H7#18.9 H7#19.9 H7#20.9 H7#21.9 H7#22.9 H7#23.9 H7#24.9 H7#25.9 H7#26.9 H7#27.9 H7#28.9 H7#29.9 H7#30.9 H7#31.9 H7#32.9 H7#33.9 H7#34.9 H7#35.9 H7#36.9 H7#37.9 H7#38.9 H7#39.9 H7#40.9 H8.3 H8#2.3 H8#3.3 H8#4.3 H8#5.3 H8#6.3 H8#7.3 H8#8.3 H8#9.3 H8#10.3 H8#11.3 H8#12.3 H8#13.3 H8#14.3 H8#15.3 H8#16.3 H8#17.3 H8#18.3 H8#19.3 H8#20.3 H8#21.3 H8#22.3 H8#23.3 H8#24.3 H8#25.3 H8#26.3 H8#27.3 H8#28.3 H8#29.3 H8#30.3 H8#31.3 H8#32.3 H8#33.3 H8#34.3 H8#35.3 H8#36.3 H8#37.3 H8#38.3 H8#39.3 H8#40.3 LED3.1 U1.1 U1.2 U1.3 U1.4 U1.7 U1#2.1 U1#2.2 U1#2.3 U1#2.4 U1#2.7 U1#3.1 U1#3.2 U1#3.3 U1#3.4 U1#3.7 U1#4.1 U1#4.2 U1#4.3 U1#4.4 U1#4.7 U1#5.1 U1#5.2 U1#5.3 U1#5.4 U1#5.7 U1#6.1 U1#6.2 U1#6.3 U1#6.4 U1#6.7 U1#7.1 U1#7.2 U1#7.3 U1#7.4 U1#7.7 U1#8.1 U1#8.2 U1#8.3 U1#8.4 U1#8.7 U1#9.1 U1#9.2 U1#9.3 U1#9.4 U1#9.7 U1#10.1 U1#10.2 U1#10.3 U1#10.4 U1#10.7 U1#11.1 U1#11.2 U1#11.3 U1#11.4 U1#11.7 U1#12.1 U1#12.2 U1#12.3 U1#12.4 U1#12.7 U1#13.1 U1#13.2 U1#13.3 U1#13.4 U1#13.7 U1#14.1 U1#14.2 U1#14.3 U1#14.4 U1#14.7 U1#15.1 U1#15.2 U1#15.3 U1#15.4 U1#15.7 U1#16.1 U1#16.2 U1#16.3 U1#16.4 U1#16.7 U1#17.1 U1#17.2 U1#17.3 U1#17.4 U1#17.7 U1#18.1 U1#18.2 U1#18.3 U1#18.4 U1#18.7 U1#19.1 U1#19.2 U1#19.3 U1#19.4 U1#19.7 U1#20.1 U1#20.2 U1#20.3 U1#20.4 U1#20.7 U1#21.1 U1#21.2 U1#21.3 U1#21.4 U1#21.7 U1#22.1 U1#22.2 U1#22.3 U1#22.4 U1#22.7 U1#23.1 U1#23.2 U1#23.3 U1#23.4 U1#23.7 U1#24.1 U1#24.2 U1#24.3 U1#24.4 U1#24.7 U1#25.1 U1#25.2 U1#25.3 U1#25.4 U1#25.7 U1#26.1 U1#26.2 U1#26.3 U1#26.4 U1#26.7 U1#27.1 U1#27.2 U1#27.3 U1#27.4 U1#27.7 U1#28.1 U1#28.2 U1#28.3 U1#28.4 U1#28.7 U1#29.1 U1#29.2 U1#29.3 U1#29.4 U1#29.7 U1#30.1 U1#30.2 U1#30.3 U1#30.4 U1#30.7 U1#31.1 U1#31.2 U1#31.3 U1#31.4 U1#31.7 U1#32.1 U1#32.2 U1#32.3 U1#32.4 U1#32.7 U1#33.1 U1#33.2 U1#33.3 U1#33.4 U1#33.7 U1#34.1 U1#34.2 U1#34.3 U1#34.4 U1#34.7 U1#35.1 U1#35.2 U1#35.3 U1#35.4 U1#35.7 U1#36.1 U1#36.2 U1#36.3 U1#36.4 U1#36.7 U1#37.1 U1#37.2 U1#37.3 U1#37.4 U1#37.7 U1#38.1 U1#38.2 U1#38.3 U1#38.4 U1#38.7 U1#39.1 U1#39.2 U1#39.3 U1#39.4 U1#39.7 U1#40.1 U1#40.2 U1#40.3 U1#40.4 U1#40.7 U2.7 U2#2.7 U2#3.7 U2#4.7 U2#5.7 U2#6.7 U2#7.7 U2#8.7 U2#9.7 U2#10.7 U2#11.7 U2#12.7 U2#13.7 U2#14.7 U2#15.7 U2#16.7 U2#17.7 U2#18.7 U2#19.7 U2#20.7 U2#21.7 U2#22.7 U2#23.7 U2#24.7 U2#25.7 U2#26.7 U2#27.7 U2#28.7 U2#29.7 U2#30.7 U2#31.7 U2#32.7 U2#33.7 U2#34.7 U2#35.7 U2#36.7 U2#37.7 U2#38.7 U2#39.7 U2#40.7 U3.1 U3#2.1 U3#3.1 U3#4.1 X1.2 X1.4 X1#2.2 X1#2.4 X1#3.2 X1#3.4 X1#4.2 X1#4.4 X1#5.2 X1#5.4 X1#6.2 X1#6.4 X1#7.2 X1#7.4 X1#8.2 X1#8.4 X1#9.2 X1#9.4 X1#10.2 X1#10.4 X1#11.2 X1#11.4 X1#12.2 X1#12.4 X1#13.2 X1#13.4 X1#14.2 X1#14.4 X1#15.2 X1#15.4 X1#16.2 X1#16.4 X1#17.2 X1#17.4 X1#18.2 X1#18.4 X1#19.2 X1#19.4 X1#20.2 X1#20.4 X1#21.2 X1#21.4 X1#22.2 X1#22.4 X1#23.2 X1#23.4 X1#24.2 X1#24.4 X1#25.2 X1#25.4 X1#26.2 X1#26.4 X1#27.2 X1#27.4 X1#28.2 X1#28.4 X1#29.2 X1#29.4 X1#30.2 X1#30.4 X1#31.2 X1#31.4 X1#32.2 X1#32.4 X1#33.2 X1#33.4 X1#34.2 X1#34.4 X1#35.2 X1#35.4 X1#36.2 X1#36.4 X1#37.2 X1#37.4 X1#38.2 X1#38.4 X1#39.2 X1#39.4 X1#40.2 X1#40.4
PA1/OSC_IN: U2.5 U2#2.5 U2#3.5 U2#4.5 U2#5.5 U2#6.5 U2#7.5 U2#8.5 U2#9.5 U2#10.5 U2#11.5 U2#12.5 U2#13.5 U2#14.5 U2#15.5 U2#16.5 U2#17.5 U2#18.5 U2#19.5 U2#20.5 U2#21.5 U2#22.5 U2#23.5 U2#24.5 U2#25.5 U2#26.5 U2#27.5 U2#28.5 U2#29.5 U2#30.5 U2#31.5 U2#32.5 U2#33.5 U2#34.5 U2#35.5 U2#36.5 U2#37.5 U2#38.5 U2#39.5 U2#40.5 X1.1 X1#2.1 X1#3.1 X1#4.1 X1#5.1 X1#6.1 X1#7.1 X1#8.1 X1#9.1 X1#10.1 X1#11.1 X1#12.1 X1#13.1 X1#14.1 X1#15.1 X1#16.1 X1#17.1 X1#18.1 X1#19.1 X1#20.1 X1#21.1 X1#22.1 X1#23.1 X1#24.1 X1#25.1 X1#26.1 X1#27.1 X1#28.1 X1#29.1 X1#30.1 X1#31.1 X1#32.1 X1#33.1 X1#34.1 X1#35.1 X1#36.1 X1#37.1 X1#38.1 X1#39.1 X1#40.1
PA2/SOC_OUT: U2.6 U2#2.6 U2#3.6 U2#4.6 U2#5.6 U2#6.6 U2#7.6 U2#8.6 U2#9.6 U2#10.6 U2#11.6 U2#12.6 U2#13.6 U2#14.6 U2#15.6 U2#16.6 U2#17.6 U2#18.6 U2#19.6 U2#20.6 U2#21.6 U2#22.6 U2#23.6 U2#24.6 U2#25.6 U2#26.6 U2#27.6 U2#28.6 U2#29.6 U2#30.6 U2#31.6 U2#32.6 U2#33.6 U2#34.6 U2#35.6 U2#36.6 U2#37.6 U2#38.6 U2#39.6 U2#40.6 X1.3 X1#2.3 X1#3.3 X1#4.3 X1#5.3 X1#6.3 X1#7.3 X1#8.3 X1#9.3 X1#10.3 X1#11.3 X1#12.3 X1#13.3 X1#14.3 X1#15.3 X1#16.3 X1#17.3 X1#18.3 X1#19.3 X1#20.3 X1#21.3 X1#22.3 X1#23.3 X1#24.3 X1#25.3 X1#26.3 X1#27.3 X1#28.3 X1#29.3 X1#30.3 X1#31.3 X1#32.3 X1#33.3 X1#34.3 X1#35.3 X1#36.3 X1#37.3 X1#38.3 X1#39.3 X1#40.3
PA3/SPI_CS: U2.10 U2#2.10 U2#3.10 U2#4.10 U2#5.10 U2#6.10 U2#7.10 U2#8.10 U2#9.10 U2#10.10 U2#11.10 U2#12.10 U2#13.10 U2#14.10 U2#15.10 U2#16.10 U2#17.10 U2#18.10 U2#19.10 U2#20.10 U2#21.10 U2#22.10 U2#23.10 U2#24.10 U2#25.10 U2#26.10 U2#27.10 U2#28.10 U2#29.10 U2#30.10 U2#31.10 U2#32.10 U2#33.10 U2#34.10 U2#35.10 U2#36.10 U2#37.10 U2#38.10 U2#39.10 U2#40.10
PB0/NRST: H7.2 H7#2.2 H7#3.2 H7#4.2 H7#5.2 H7#6.2 H7#7.2 H7#8.2 H7#9.2 H7#10.2 H7#11.2 H7#12.2 H7#13.2 H7#14.2 H7#15.2 H7#16.2 H7#17.2 H7#18.2 H7#19.2 H7#20.2 H7#21.2 H7#22.2 H7#23.2 H7#24.2 H7#25.2 H7#26.2 H7#27.2 H7#28.2 H7#29.2 H7#30.2 H7#31.2 H7#32.2 H7#33.2 H7#34.2 H7#35.2 H7#36.2 H7#37.2 H7#38.2 H7#39.2 H7#40.2 U2.4 U2#2.4 U2#3.4 U2#4.4 U2#5.4 U2#6.4 U2#7.4 U2#8.4 U2#9.4 U2#10.4 U2#11.4 U2#12.4 U2#13.4 U2#14.4 U2#15.4 U2#16.4 U2#17.4 U2#18.4 U2#19.4 U2#20.4 U2#21.4 U2#22.4 U2#23.4 U2#24.4 U2#25.4 U2#26.4 U2#27.4 U2#28.4 U2#29.4 U2#30.4 U2#31.4 U2#32.4 U2#33.4 U2#34.4 U2#35.4 U2#36.4 U2#37.4 U2#38.4 U2#39.4 U2#40.4
PB1/UART1_TX/SWDIO: H4.2 H4#2.2 H4#3.2 H4#4.2 H4#5.2 H4#6.2 H4#7.2 H4#8.2 H4#9.2 H4#10.2 H4#11.2 H4#12.2 H4#13.2 H4#14.2 H4#15.2 H4#16.2 H4#17.2 H4#18.2 H4#19.2 H4#20.2 H4#21.2 H4#22.2 H4#23.2 H4#24.2 H4#25.2 H4#26.2 H4#27.2 H4#28.2 H4#29.2 H4#30.2 H4#31.2 H4#32.2 H4#33.2 H4#34.2 H4#35.2 H4#36.2 H4#37.2 H4#38.2 H4#39.2 H4#40.2 H8.4 H8#2.4 H8#3.4 H8#4.4 H8#5.4 H8#6.4 H8#7.4 H8#8.4 H8#9.4 H8#10.4 H8#11.4 H8#12.4 H8#13.4 H8#14.4 H8#15.4 H8#16.4 H8#17.4 H8#18.4 H8#19.4 H8#20.4 H8#21.4 H8#22.4 H8#23.4 H8#24.4 H8#25.4 H8#26.4 H8#27.4 H8#28.4 H8#29.4 H8#30.4 H8#31.4 H8#32.4 H8#33.4 H8#34.4 H8#35.4 H8#36.4 H8#37.4 H8#38.4 H8#39.4 H8#40.4 U2.8 U2#2.8 U2#3.8 U2#4.8 U2#5.8 U2#6.8 U2#7.8 U2#8.8 U2#9.8 U2#10.8 U2#11.8 U2#12.8 U2#13.8 U2#14.8 U2#15.8 U2#16.8 U2#17.8 U2#18.8 U2#19.8 U2#20.8 U2#21.8 U2#22.8 U2#23.8 U2#24.8 U2#25.8 U2#26.8 U2#27.8 U2#28.8 U2#29.8 U2#30.8 U2#31.8 U2#32.8 U2#33.8 U2#34.8 U2#35.8 U2#36.8 U2#37.8 U2#38.8 U2#39.8 U2#40.8
